# EasyEDA Pro project Cerberus_Sub_Controller_v02.eprj, schematic Cerberus_Sub_Controller_v02, sheets 2 to 3 of 3

## Sheets
2 A2: Page Name: A2
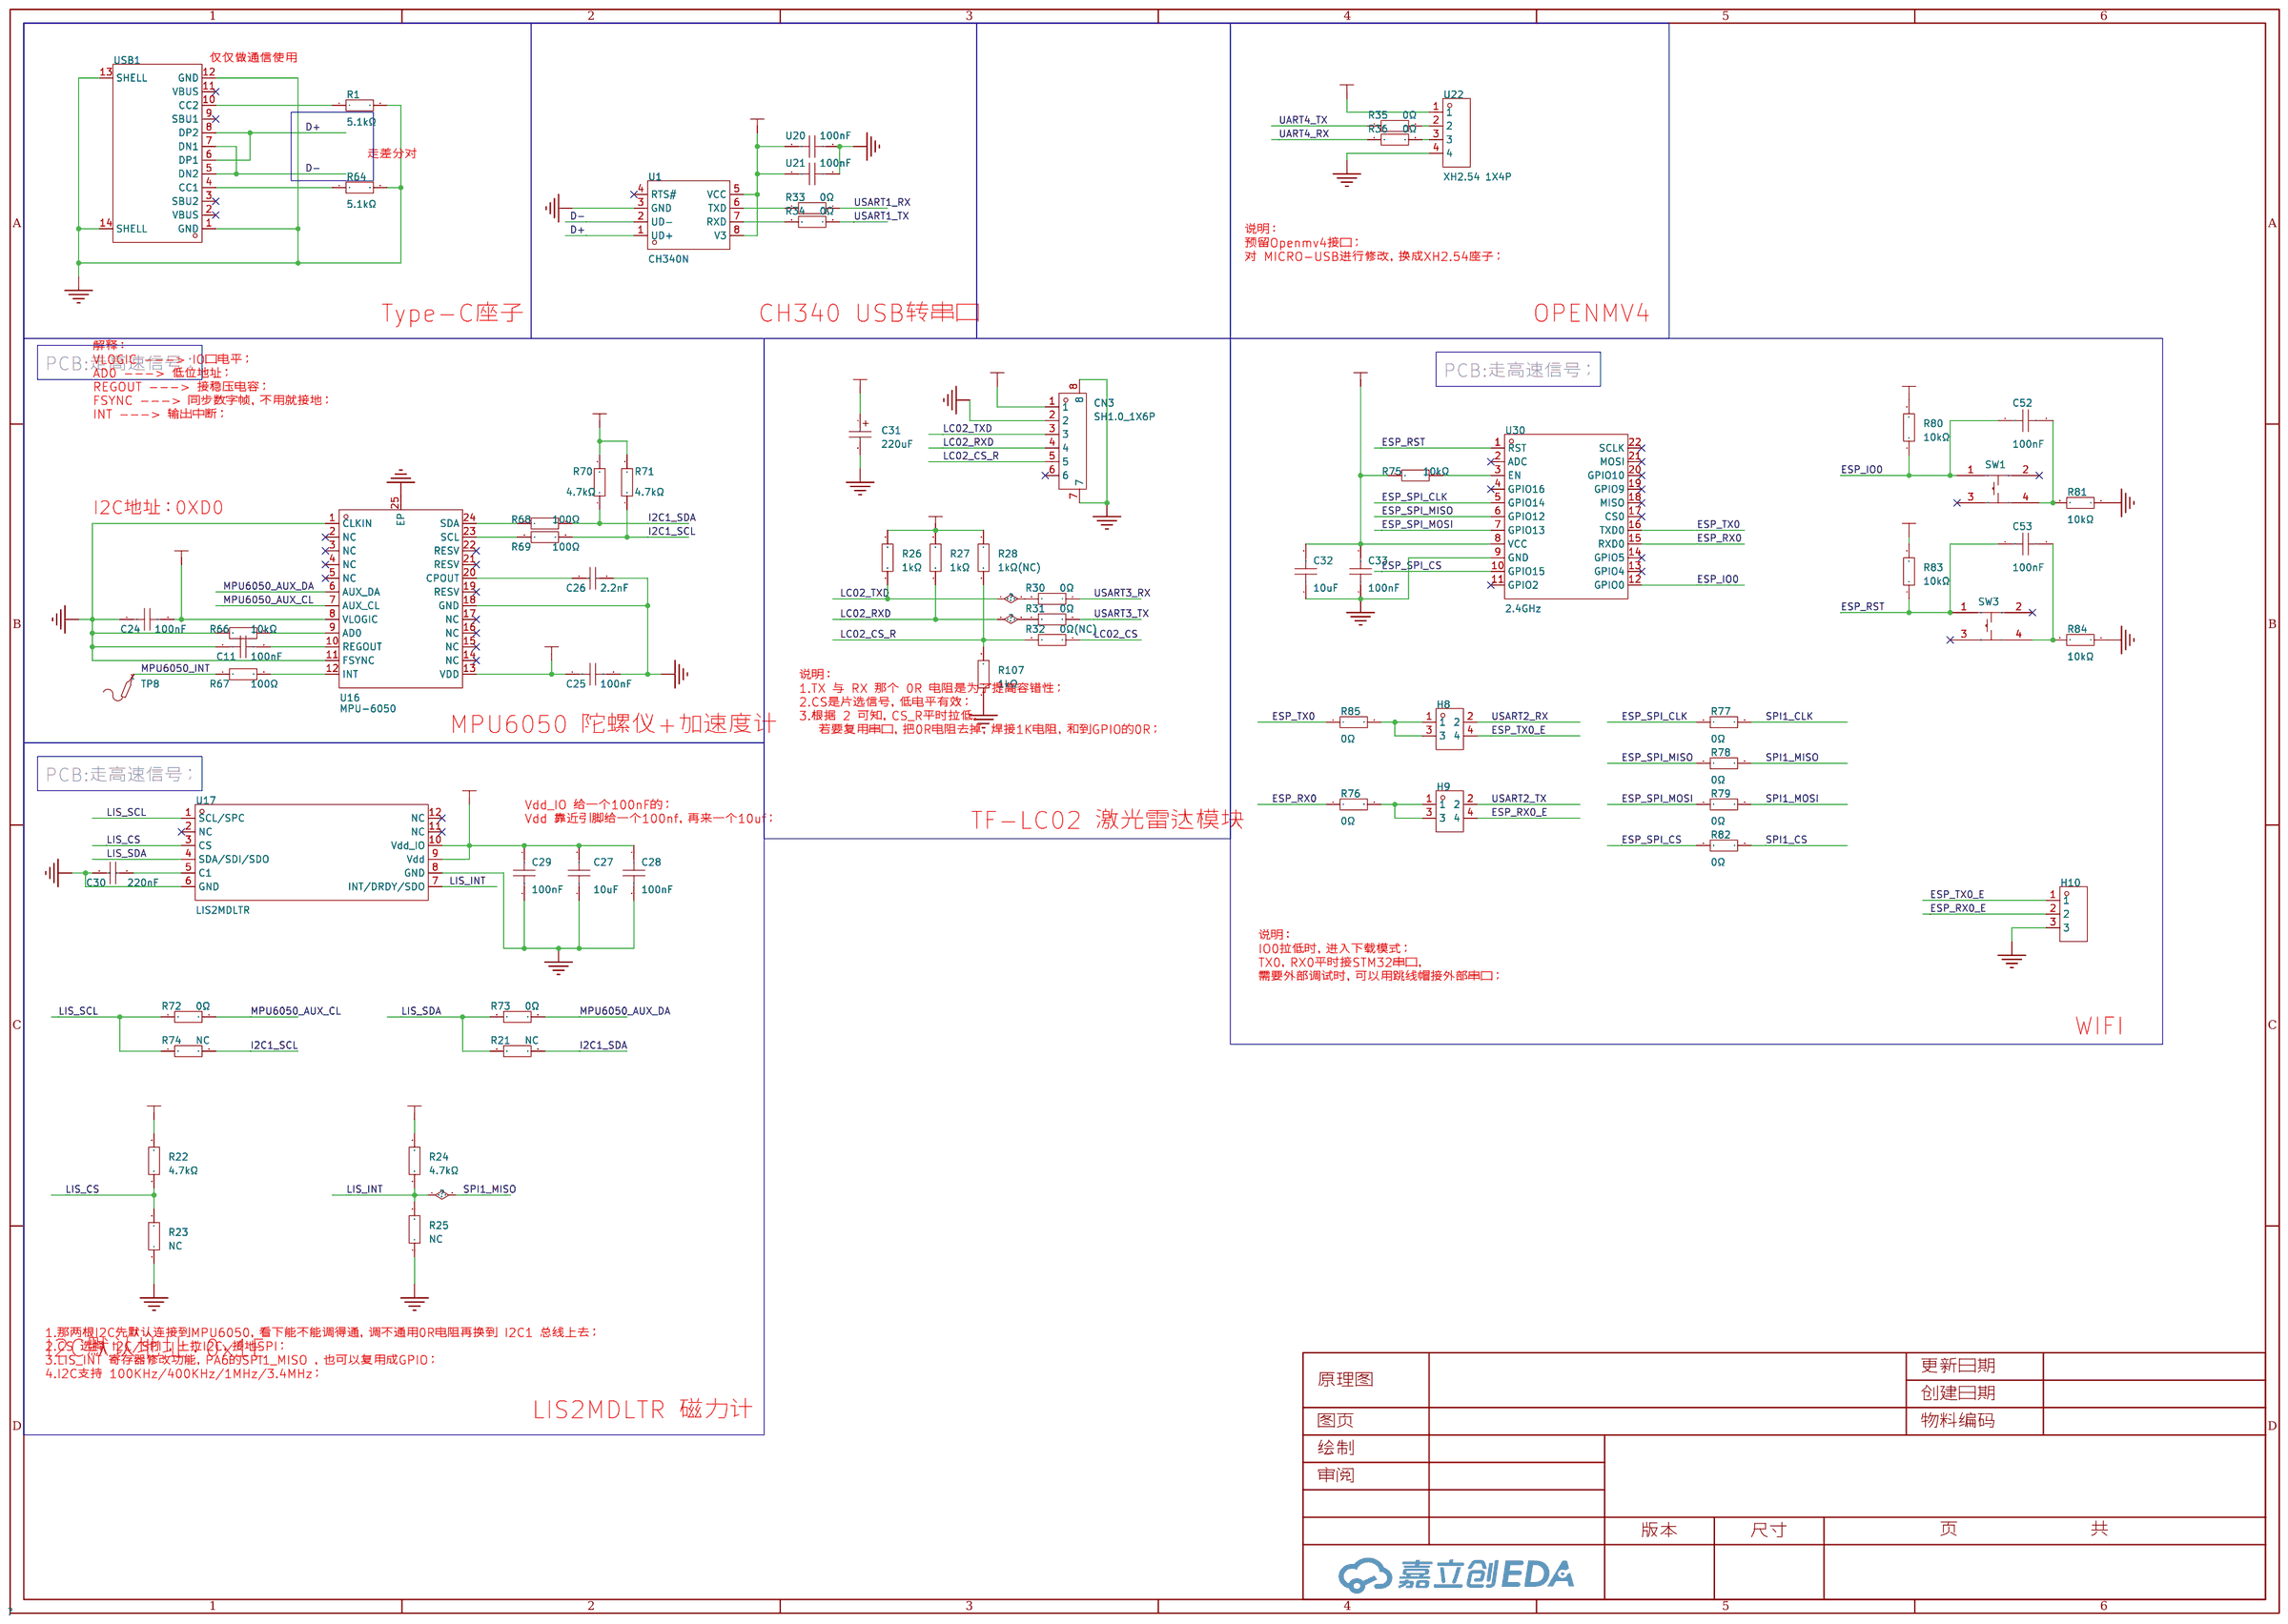
[diagram p1: A2]
3 A3: Page Name: A3
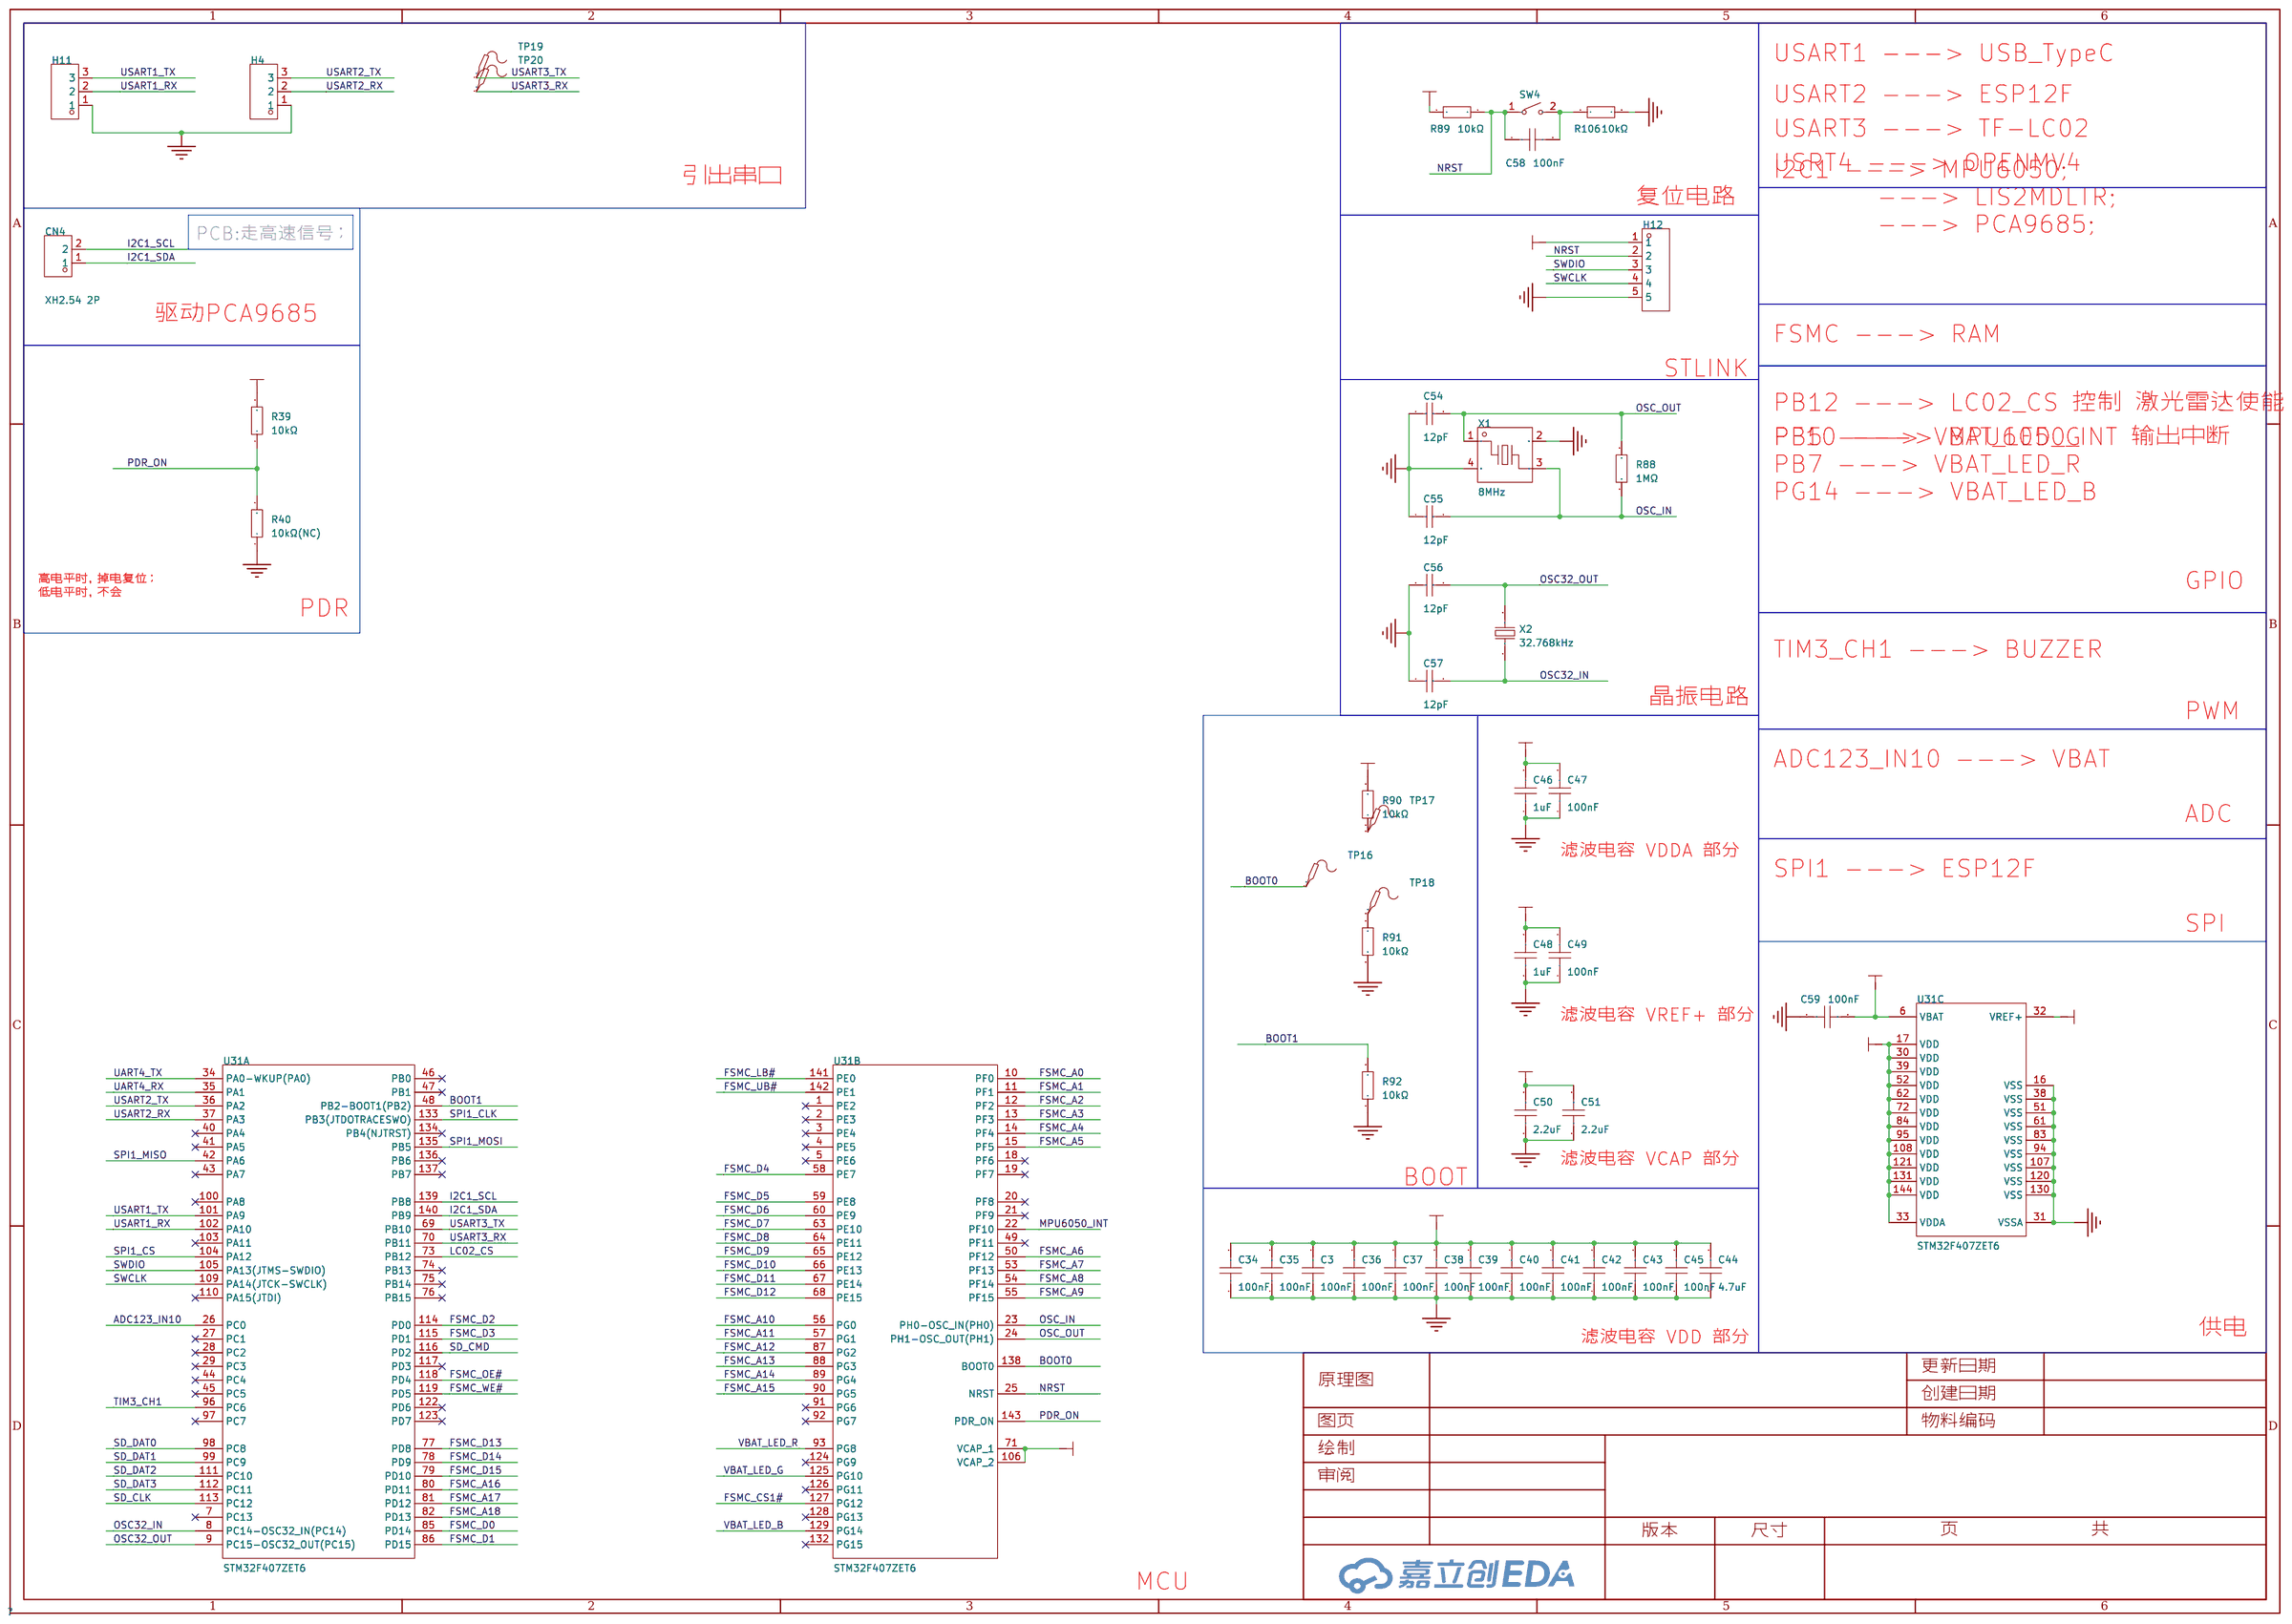
[diagram p2: A3]

## Parts
sheet A2
C11  100nF  [C0402]
C24  100nF  [C0402]
C25  100nF  [C0402]
C26  2.2nF  [C0402]
C27  10uF  [C0402]
C28  100nF  [C0402]
C29  100nF  [C0402]
C30  220nF  [C0402]
C31  220uF  [CAP-SMD_L3.5-W2.8-R-RD]
C32  10uF  [C0603]
C33  100nF  [C0603]
C52  100nF  [C0603]
C53  100nF  [C0603]
CN3  SH1.0_1X6P  [CONN-SMD_6P-P1.00_XUNPU_WAFER-SH1.0-6PWB]
H8  PZ254V-12-4P  [HDR-TH_4P-P2.54-V-M-R2-C2-S2.54]
H9  PZ254V-12-4P  [HDR-TH_4P-P2.54-V-M-R2-C2-S2.54]
H10  PZ254V-11-03P  [HDR-TH_3P-P2.54-V-M]
R1  5.1kΩ  [R0603]
R21  NC  [R0402]
R22  4.7kΩ  [R0402]
R23  NC  [R0402]
R24  4.7kΩ  [R0402]
R25  NC  [R0402]
R26  1kΩ  [R0603]
R27  1kΩ  [R0603]
R28  1kΩ(NC)  [R0603]
R30  0Ω  [R0603]
R31  0Ω  [R0603]
R32  0Ω(NC)  [R0603]
R33  0Ω  [R0603]
R34  0Ω  [R0603]
R35  0Ω  [R0603]
R36  0Ω  [R0603]
R64  5.1kΩ  [R0603]
R66  10kΩ  [R0402]
R67  100Ω  [R0402]
R68  100Ω  [R0402]
R69  100Ω  [R0402]
R70  4.7kΩ  [R0603]
R71  4.7kΩ  [R0603]
R72  0Ω  [R0402]
R73  0Ω  [R0402]
R74  NC  [R0402]
R75  10kΩ  [R0603]
R76  0Ω  [R0603]
R77  0Ω  [R0603]
R78  0Ω  [R0603]
R79  0Ω  [R0603]
R80  10kΩ  [R0603]
R81  10kΩ  [R0603]
R82  0Ω  [R0603]
R83  10kΩ  [R0603]
R84  10kΩ  [R0603]
R85  0Ω  [R0603]
R107  1kΩ  [R0603]
SW1  TS-1009S-04526  [SW-SMD_4P-L4.5-W4.5-P3.00-LS7.0]
SW3  TS-1009S-04526  [SW-SMD_4P-L4.5-W4.5-P3.00-LS7.0]
TP8  -  [Test-Point-0.5mm]
U1  CH340N  [SOP-8_L4.9-W3.9-P1.27-LS6.0-BL]
U16  MPU-6050  [QFN-24_L4.0-W4.0-P0.50-BL-EP2.7]
U17  LIS2MDLTR  [LGA-12_L2.0-W2.0-P0.50-BL]
U20  100nF  [C0603]
U21  100nF  [C0603]
U22  XH2.54 1X4P  [CONN-TH_4P-P2.50_4PIN]
U30  2.4GHz  [WIFIM-SMD_ESP-12F-ESP8266MOD]
USB1  TYPE-C 16PIN 2MD(073)  [USB-C-SMD_TYPE-C-6PIN-2MD-073]
sheet A3
C3  100nF  [C0402]
C34  100nF  [C0402]
C35  100nF  [C0402]
C36  100nF  [C0402]
C37  100nF  [C0402]
C38  100nF  [C0402]
C39  100nF  [C0402]
C40  100nF  [C0402]
C41  100nF  [C0402]
C42  100nF  [C0402]
C43  100nF  [C0402]
C44  4.7uF  [C0402]
C45  100nF  [C0402]
C46  1uF  [C0402]
C47  100nF  [C0402]
C48  1uF  [C0402]
C49  100nF  [C0402]
C50  2.2uF  [C0402]
C51  2.2uF  [C0402]
C54  12pF  [C0402]
C55  12pF  [C0402]
C56  12pF  [C0402]
C57  12pF  [C0402]
C58  100nF  [C0402]
C59  100nF  [C0402]
CN4  XH2.54 2P  [CONN-TH_2P-P2.50_HX25003-2A]
H4  PZ254V-11-03P  [HDR-TH_3P-P2.54-V-M]
H11  PZ254V-11-03P  [HDR-TH_3P-P2.54-V-M]
H12  PZ254V-11-05P  [HDR-TH_5P-P2.54-V-M]
R39  10kΩ  [R0603]
R40  10kΩ(NC)  [R0603]
R88  1MΩ  [R0402]
R89  10kΩ  [R0402]
R90  10kΩ  [R0402]
R91  10kΩ  [R0402]
R92  10kΩ  [R0402]
R106  10kΩ  [R0402]
SW4  TS-1088R-02026  [SW-SMD_L3.9-W3.0-P4.45]
TP16  -  [Test-Point-0.5mm]
TP17  -  [Test-Point-0.5mm]
TP18  -  [Test-Point-0.5mm]
TP19  -  [Test-Point-0.5mm]
TP20  -  [Test-Point-0.5mm]
U31  STM32F407ZET6  [LQFP-144_L20.0-W20.0-P0.50-LS22.0-BL]  (sections 1,2,3)
X1  8MHz  [OSC-SMD_4P-L3.2-W2.5-BL]
X2  32.768kHz  [FC-135R_L3.2-W1.5]

## Library data of the parts
C3 C11 C24 C25 C28 C29 C34-C43 C45 C47 C49 C58 C59 = GRM155R71H104KE14D: 容值:100nF;精度:±10%;额定电压:50V;材质(温度系数):X7R;; LCSC Part Name: 100nF ±10% 50V; Supplier Part: C77020; Manufacturer: muRata(村田); Supplier Footprint: 0402; JLCPCB Part Class: 扩展库; Datasheet: https://atta.szlcsc.com/upload/public/pdf/source/20180326/C77020_39BD49C951FF1AF0DB1F1FAC5AC1E401.pdf; Supplier: LCSC; Tolerance: ±10%; Voltage Rated: 50V; Temperature Coefficient: X7R
C26 = CC0402KRX7R9BB222: 容值:2.2nF;精度:±10%;额定电压:50V;材质(温度系数):X7R;; LCSC Part Name: 2.2nF ±10% 50V; Supplier Part: C106861; Manufacturer: YAGEO(国巨); Supplier Footprint: 0402; JLCPCB Part Class: 扩展库; Datasheet: https://atta.szlcsc.com/upload/public/pdf/source/20170505/1493957848374.pdf; Supplier: LCSC; Tolerance: ±10%; Voltage Rated: 50V; Temperature Coefficient: X7R
C27 = CL05A106MP5NUNC: 容值:10uF;精度:±20%;额定电压:10V;材质(温度系数):X5R;; LCSC Part Name: 10uF ±20% 10V; Supplier Part: C315248; Manufacturer: SAMSUNG(三星); Supplier Footprint: 0402; JLCPCB Part Class: 扩展库; Datasheet: https://atta.szlcsc.com/upload/public/pdf/source/20231220/1EF805BAE1520675928CC4638D279E74.pdf; Supplier: LCSC; Tolerance: ±20%; Voltage Rated: 10V; Temperature Coefficient: X5R
C30 = CL05B224KO5NNNC: 容值:220nF;精度:±10%;额定电压:16V;材质(温度系数):X7R;; LCSC Part Name: 220nF ±10% 16V; Supplier Part: C16772; Manufacturer: SAMSUNG(三星); Supplier Footprint: 0402; JLCPCB Part Class: 基础库; Datasheet: https://atta.szlcsc.com/upload/public/pdf/source/20160218/1457707763339.pdf; Supplier: LCSC; Tolerance: ±10%; Voltage Rated: 16V; Temperature Coefficient: X7R
C31 = CA45-B6R3K227T: 容值:220uF;精度:±10%;额定电压:6.3V;等效串联电阻:1.2Ω@100kHz;; LCSC Part Name: 220uF ±10% 6.3V; Supplier Part: C122649; Manufacturer: 湘怡中元/湘江; Supplier Footprint: CASE-B-3528; JLCPCB Part Class: 扩展库; Datasheet: https://atta.szlcsc.com/upload/public/pdf/source/20191009/C435293_78A410F3D73489DBEAC46056C4262F7A.pdf; Supplier: LCSC; Tolerance: ±10%; Rated Voltage: 6.3V; Equivalent Series Resistance(ESR): 1.2Ω@100kHz; Operating Temperature: -55℃~+125℃
C32 = CL10A106KP8NNNC: 容值:10uF;精度:±10%;额定电压:10V;材质(温度系数):X5R;; LCSC Part Name: 10uF ±10% 10V; Supplier Part: C19702; Manufacturer: SAMSUNG(三星); Supplier Footprint: 0603; JLCPCB Part Class: 基础库; Datasheet: https://atta.szlcsc.com/upload/public/pdf/source/20160218/1457707763339.pdf; Supplier: LCSC; Tolerance: ±10%; Voltage Rated: 10V; Temperature Coefficient: X5R
C33 = CC0603KRX7R9BB104: 容值:100nF;精度:±10%;额定电压:50V;材质(温度系数):X7R;; LCSC Part Name: 100nF ±10% 50V; Supplier Part: C14663; Manufacturer: YAGEO(国巨); Supplier Footprint: 0603; JLCPCB Part Class: 基础库; Datasheet: https://atta.szlcsc.com/upload/public/pdf/source/20180910/C282072_33301C7F631E79921B82A8DAC6BCC5B3.pdf; Supplier: LCSC; Tolerance: ±10%; Voltage Rated: 50V; Temperature Coefficient: X7R
C52 C53 U20 U21 = CGA0603X7R104K500JT: 容值:100nF;精度:±10%;额定电压:50V;材质(温度系数):X7R;; LCSC Part Name: 100nF ±10% 50V; Supplier Part: C6119867; Manufacturer: HRE(芯声); Supplier Footprint: 0603; JLCPCB Part Class: 扩展库; Supplier: LCSC; Tolerance: ±10%; Voltage Rated: 50V; Temperature Coefficient: X7R
CN3 = WAFER-SH1.0-6PWB: 插针结构:1x6P;间距:1mm;安装方式:卧贴;总PIN数:6P;排数:1;每排PIN数:6;额定电流:1A;工作温度范围:-25℃~+85℃;; LCSC Part Name: 1x6P 间距:1mm 卧贴; Supplier Part: C3029345; Manufacturer: XUNPU(讯普); Supplier Footprint: SMD,P=1mm,卧贴; JLCPCB Part Class: 扩展库; Datasheet: https://atta.szlcsc.com/upload/public/pdf/source/20220527/1879B8210BD3B2006BCEAC1A40D397B6.pdf; Supplier: LCSC; Pins Structure: 1x6P; Pitch: 1mm; Mounting Style: 卧贴; Number of Pins: 6P; Number of Rows: 1; Number of PINs Per Row: 6; Current Rating (Max): 1A; Operating Temperature Range: -25℃~+85℃
H8 H9 = PZ254V-12-4P: 插针结构:2x2P;间距:2.54mm;行距:2.54mm;圆针/方针:方针;安装类型:直插;排数:双排;总PIN位数:4P;额定电流:-;额定电压:-;配合针长度:6mm;塑高:2.5mm;端接针长度:3mm;触头材质:黄铜;触头镀层:-;工作温度范围:-40℃~+105℃;颜色:黑色;; LCSC Part Name: 间距:2.54mm 2x2P 直插 方针; Supplier Part: C492419; Manufacturer: XFCN(兴飞); Supplier Footprint: 插件,P=2.54mm; JLCPCB Part Class: 扩展库; Datasheet: https://atta.szlcsc.com/upload/public/pdf/source/20200309/C492419_0001C06E73AFF21BD0ED3D7CEEF46D29.pdf; Supplier: LCSC; Pin Structure: 2x2P; Pitch: 2.54mm; Row Spacing: 2.54mm; Circluar Pins/Square Pins: 方针; Mounting Type: 直插; Number of Rows: 双排; Number of Pins: 4P; Length of Mating Pin: 6mm; Insulation Height: 2.5mm; Length of End Connection Pin: 3mm; Contact Material: 黄铜; Operating Temperature Range: -40℃~+105℃; Color: 黑色
H4 H10 H11 = PZ254V-11-03P: 插针结构:1x3P;间距:2.54mm;行距:-;圆针/方针:方针;安装类型:直插;排数:单排;总PIN位数:3P;额定电流:3A;额定电压:250V;配合针长度:6mm;塑高:2.5mm;端接针长度:3mm;工作温度范围:-40℃~+105℃;颜色:黑色;; LCSC Part Name: 间距:2.54mm 1x3P 直插 方针; Supplier Part: C2937625; Manufacturer: XFCN(兴飞); Supplier Footprint: 插件,P=2.54mm; JLCPCB Part Class: 扩展库; Datasheet: https://atta.szlcsc.com/upload/public/pdf/source/20200309/C492402_8335C3D49C4E4C618838D59BB1D024C1.pdf; Supplier: LCSC; Pin Structure: 1x3P; Pitch: 2.54mm; Circluar Pins/Square Pins: 方针; Mounting Type: 直插; Number of Rows: 单排; Number of Pins: 3P; Current Rating (Max): 3A; Voltage Rating (Max): 250V; Length of Mating Pin: 6mm; Insulation Height: 2.5mm; Length of End Connection Pin: 3mm; Operating Temperature Range: -40℃~+105℃; Color: 黑色
R1 R64 = 0603WAF5101T5E: 电阻类型:厚膜电阻;阻值:5.1kΩ;精度:±1%;功率:100mW;最大工作电压:75V;温度系数:±100ppm/℃;; LCSC Part Name: 5.1kΩ ±1% 100mW 厚膜电阻; Supplier Part: C23186; Manufacturer: UNI-ROYAL(厚声); Supplier Footprint: 0603; JLCPCB Part Class: 基础库; Datasheet: https://atta.szlcsc.com/upload/public/pdf/source/20200306/C422600_1E6D84923E4A46A82E41ADD87F860B5C.pdf; Supplier: LCSC; Type: 厚膜电阻; Tolerance: ±1%; Power(Watts): 100mW; Overload Voltage (Max): 75V; Temperature Coefficient: ±100ppm/℃; Operating Temperature Range: -55℃~+155℃
R21 R72-R74 = 0402WGF0000TCE: 电阻类型:厚膜电阻;阻值:0Ω;精度:±1%;功率:62.5mW;最大工作电压:50V;温度系数:±800ppm/℃;; LCSC Part Name: 0Ω ±1% 62.5mW 厚膜电阻; Supplier Part: C17168; Manufacturer: UNI-ROYAL(厚声); Supplier Footprint: 0402; JLCPCB Part Class: 基础库; Datasheet: https://atta.szlcsc.com/upload/public/pdf/source/20200306/C422600_1E6D84923E4A46A82E41ADD87F860B5C.pdf; Supplier: LCSC; Type: 厚膜电阻; Tolerance: ±1%; Power(Watts): 62.5mW; Overload Voltage (Max): 50V; Temperature Coefficient: ±800ppm/℃; Operating Temperature Range: -55℃~+155℃
R22-R25 = 0402WGJ0472TCE: 电阻类型:厚膜电阻;阻值:4.7kΩ;精度:±5%;功率:62.5mW;最大工作电压:50V;温度系数:±100ppm/℃;; LCSC Part Name: 4.7kΩ ±5% 62.5mW 厚膜电阻; Supplier Part: C25940; Manufacturer: UNI-ROYAL(厚声); Supplier Footprint: 0402; JLCPCB Part Class: 扩展库; Datasheet: https://atta.szlcsc.com/upload/public/pdf/source/20200306/C422600_1E6D84923E4A46A82E41ADD87F860B5C.pdf; Supplier: LCSC; Type: 厚膜电阻; Tolerance: ±5%; Power(Watts): 62.5mW; Overload Voltage (Max): 50V; Temperature Coefficient: ±100ppm/℃; Operating Temperature Range: -55℃~+155℃
R26-R28 R107 = RC0603FR-071KL: 电阻类型:厚膜电阻;阻值:1kΩ;精度:±1%;功率:100mW;最大工作电压:75V;温度系数:±100ppm/℃;; LCSC Part Name: 厚膜电阻 1kΩ ±1% 100mW; Supplier Part: C22548; Manufacturer: YAGEO(国巨); Supplier Footprint: 0603; JLCPCB Part Class: 扩展库; Datasheet: https://atta.szlcsc.com/upload/public/pdf/source/20180316/70C0E2BDAE7FCC62C531A5A58D202EE1.pdf; Supplier: LCSC; Type: 厚膜电阻; Tolerance: ±1%; Power(Watts): 100mW; Overload Voltage (Max): 75V; Temperature Coefficient: ±100ppm/℃; Operating Temperature Range: -55℃~+155℃
R30-R36 R76-R79 R82 R85 = 0603WAF0000T5E: 电阻类型:厚膜电阻;阻值:0Ω;精度:±1%;功率:100mW;最大工作电压:75V;; LCSC Part Name: 0Ω ±1% 100mW 厚膜电阻; Supplier Part: C21189; Manufacturer: UNI-ROYAL(厚声); Supplier Footprint: 0603; JLCPCB Part Class: 基础库; Datasheet: https://atta.szlcsc.com/upload/public/pdf/source/20200306/C422600_1E6D84923E4A46A82E41ADD87F860B5C.pdf; Supplier: LCSC; Type: 厚膜电阻; Tolerance: ±1%; Power(Watts): 100mW; Overload Voltage (Max): 75V; Operating Temperature Range: -55℃~+155℃
R66 R89-R92 R106 = RC0402FR-0710KL: 电阻类型:厚膜电阻;阻值:10kΩ;精度:±1%;功率:62.5mW;最大工作电压:50V;温度系数:±100ppm/℃;; LCSC Part Name: 厚膜电阻 10kΩ ±1% 62.5mW; Supplier Part: C60490; Manufacturer: YAGEO(国巨); Supplier Footprint: 0402; JLCPCB Part Class: 扩展库; Datasheet: https://atta.szlcsc.com/upload/public/pdf/source/20170925/C131467_1506321478108990263.pdf; Supplier: LCSC; Type: 厚膜电阻; Tolerance: ±1%; Power(Watts): 62.5mW; Overload Voltage (Max): 50V; Temperature Coefficient: ±100ppm/℃; Operating Temperature Range: -55℃~+155℃
R67-R69 = 0402WGF1000TCE: 电阻类型:厚膜电阻;阻值:100Ω;精度:±1%;功率:62.5mW;最大工作电压:50V;温度系数:±200ppm/℃;; LCSC Part Name: 100Ω ±1% 62.5mW 厚膜电阻; Supplier Part: C25076; Manufacturer: UNI-ROYAL(厚声); Supplier Footprint: 0402; JLCPCB Part Class: 基础库; Datasheet: https://atta.szlcsc.com/upload/public/pdf/source/20200306/C422600_1E6D84923E4A46A82E41ADD87F860B5C.pdf; Supplier: LCSC; Type: 厚膜电阻; Tolerance: ±1%; Power(Watts): 62.5mW; Overload Voltage (Max): 50V; Temperature Coefficient: ±200ppm/℃; Operating Temperature Range: -55℃~+155℃
R70 R71 = 0603WAF4701T5E: 电阻类型:厚膜电阻;阻值:4.7kΩ;精度:±1%;功率:100mW;最大工作电压:75V;温度系数:±100ppm/℃;; LCSC Part Name: 4.7kΩ ±1% 100mW 厚膜电阻; Supplier Part: C23162; Manufacturer: UNI-ROYAL(厚声); Supplier Footprint: 0603; JLCPCB Part Class: 基础库; Datasheet: https://atta.szlcsc.com/upload/public/pdf/source/20200306/C422600_1E6D84923E4A46A82E41ADD87F860B5C.pdf; Supplier: LCSC; Type: 厚膜电阻; Tolerance: ±1%; Power(Watts): 100mW; Overload Voltage (Max): 75V; Temperature Coefficient: ±100ppm/℃; Operating Temperature Range: -55℃~+155℃
R39 R40 R75 R80 R81 R83 R84 = 0603WAF1002T5E: 电阻类型:厚膜电阻;阻值:10kΩ;精度:±1%;功率:100mW;最大工作电压:75V;温度系数:±100ppm/℃;; LCSC Part Name: 厚膜电阻 10kΩ ±1% 100mW; Supplier Part: C25804; Manufacturer: UNI-ROYAL(厚声); Supplier Footprint: 0603; JLCPCB Part Class: 基础库; Datasheet: https://atta.szlcsc.com/upload/public/pdf/source/20200306/C422600_1E6D84923E4A46A82E41ADD87F860B5C.pdf; Supplier: LCSC; Type: 厚膜电阻; Tolerance: ±1%; Power(Watts): 100mW; Overload Voltage (Max): 75V; Temperature Coefficient: ±100ppm/℃; Operating Temperature Range: -55℃~+155℃
SW1 SW3 = TS-1009S-04526: 电路结构:单刀单掷;按钮形状:圆形按钮;安装方式:立贴;开关长度:4.5mm;开关宽度:4.5mm;开关高度:4.5mm;触点电流:50mA;额定电压(DC):12V;带灯:-;机械寿命:-;; LCSC Part Name: 4.5*4.5*4.5mm 立贴 轻触开关; Supplier Part: C455245; Manufacturer: XUNPU(讯普); Supplier Footprint: SMD,4.5x4.5mm; JLCPCB Part Class: 扩展库; Datasheet: https://atta.szlcsc.com/upload/public/pdf/source/20191118/C455248_D35D7E271EC7BD44939E7F982BCB1632.pdf; Supplier: LCSC; Circuit: 单刀单掷; Actuator Style: 圆形按钮; Mounting Style: 立贴; Switch Length: 4.5mm; Switch Width: 4.5mm; Switch Height: 4.5mm; Contact Current: 50mA; Voltage Rating (DC): 12V
TP8 TP16-TP20 = Test-Point: Test Point 测试点
U1 = CH340N: LCSC Part Name: USB转串口芯片 CH340; Supplier Part: C2977777; Manufacturer: WCH(南京沁恒); Supplier Footprint: SOP-8; JLCPCB Part Class: 扩展库; Datasheet: https://atta.szlcsc.com/upload/public/pdf/source/20230530/6E401E9554E9F5311886CC8B3F89B62E.pdf; Supplier: LCSC
U16 = MPU-6050: 传感器类型:加速度计陀螺仪;; Supplier Part: C24112; Manufacturer: TDK InvenSense(应美盛); Supplier Footprint: QFN-24-EP(4x4); JLCPCB Part Class: 扩展库; Datasheet: https://atta.szlcsc.com/upload/public/pdf/source/20140425/1457707046159.pdf; Supplier: LCSC; Sensor Type: 加速度计陀螺仪; Operating Temperature: -40℃~+85℃
U17 = LIS2MDLTR: 磁传感器、数字输出、50高斯磁场动态范围、超低功耗、高性能、3轴磁力计; LCSC Part Name: 霍尔效应开关; Supplier Part: C919695; Manufacturer: ST(意法半导体); Supplier Footprint: LGA-12(2x2); JLCPCB Part Class: 扩展库; Datasheet: https://atta.szlcsc.com/upload/public/pdf/source/20211119/145E3A73C2A09E2C981D93C27CF540FA.pdf; Supplier: LCSC
U22 = ZX-XH2.54-4PZZ: 插针结构:1x4P;间距:2.54mm;安装方式:直插;参考系列:XH;总PIN数:4P;排数:1;每排PIN数:4;行距:-;额定电流:3A;触头材质:黄铜;触头镀层:锡;工作温度范围:-25℃~+85℃;; Supplier Part: C7429634; Manufacturer: Megastar(兆星); Supplier Footprint: 插件,P=2.54mm; JLCPCB Part Class: 扩展库; Datasheet: https://atta.szlcsc.com/upload/public/pdf/source/20230619/B529A2163E0159A644AB3383D208FB03.pdf; Supplier: LCSC; Pins Structure: 1x4P; Pitch: 2.54mm; Mounting Style: 直插; Reference Series: XH; Number of Pins: 4P; Number of Rows: 1; Number of PINs Per Row: 4; Current Rating (Max): 3A; Contact Material: 黄铜; Contact Plating: 锡; Operating Temperature Range: -25℃~+85℃
U30 = ESP-12F(ESP8266MOD): 核心处理器:ESP8266芯片;频率:2.4GHz;天线形式:板载PCB天线;发射功率:16dBm;接收灵敏度:-90dBm;; LCSC Part Name: 完整的802.11b/g/nWi-FiSoC模块; Supplier Part: C82891; Manufacturer: Ai-Thinker(安信可); Supplier Footprint: SMD,16x24mm; JLCPCB Part Class: 扩展库; Datasheet: https://atta.szlcsc.com/upload/public/pdf/source/20210219/C82891_ABD84A460F4F056A2757267CCCA4B508.pdf; Supplier: LCSC; Core Processor: ESP8266芯片; Support Interface: GPIO；UART；I2C；PWM；SPI；ADC; Antenna Type: 板载PCB天线; Output Power: 16dBm; Operating Voltage: 3.3V; Receive  Current: 120mA; Send  Current: 170mA; Sensitivity: -90dBm; Operating Temperature: -40℃~+85℃
USB1 = TYPE-C 16PIN 2MD(073): 连接器类型:Type-C;标准:-;公母:母;端口数量:1;触点数量:16P;安装方式:卧贴;额定电流 - 电源:5A;工作温度范围:-25℃~+85℃;; LCSC Part Name: Type-C 母 卧贴; Supplier Part: C2765186; Manufacturer: SHOU HAN(首韩); Supplier Footprint: SMD; JLCPCB Part Class: 扩展库; Datasheet: https://atta.szlcsc.com/upload/public/pdf/source/20211123/39B17C16241EAC15C5E277BDA434118E.pdf; Supplier: LCSC; Connector Type: Type-C; Gender: 母; Number of Ports: 1; Number of Contacts: 16P; Mounting Style: 卧贴; Current Rating - Power (Max): 5A; Operating Temperature Range: -25℃~+85℃
C44 = CL05A475KP5NRNC: 容值:4.7uF;精度:±10%;额定电压:10V;材质(温度系数):X5R;; LCSC Part Name: 4.7uF ±10% 10V; Supplier Part: C368809; Manufacturer: SAMSUNG(三星); Supplier Footprint: 0402; JLCPCB Part Class: 扩展库; Datasheet: https://atta.szlcsc.com/upload/public/pdf/source/20160218/1457707763339.pdf; Supplier: LCSC; Tolerance: ±10%; Voltage Rated: 10V; Temperature Coefficient: X5R
C46 C48 = CL05A105KA5NQNC: 容值:1uF;精度:±10%;额定电压:25V;材质(温度系数):X5R;; LCSC Part Name: 1uF ±10% 25V; Supplier Part: C52923; Manufacturer: SAMSUNG(三星); Supplier Footprint: 0402; JLCPCB Part Class: 基础库; Datasheet: https://atta.szlcsc.com/upload/public/pdf/source/20160218/1457707763339.pdf; Supplier: LCSC; Tolerance: ±10%; Voltage Rated: 25V; Temperature Coefficient: X5R
C50 C51 = GRM155R61E225KE11D: 容值:2.2uF;精度:±10%;额定电压:25V;材质(温度系数):X5R;; LCSC Part Name: 2.2uF ±10% 25V; Supplier Part: C385032; Manufacturer: muRata(村田); Supplier Footprint: 0402; JLCPCB Part Class: 扩展库; Datasheet: https://atta.szlcsc.com/upload/public/pdf/source/20190531/C385032_AE390FF415271BC6A7223A7F56F516ED.pdf; Supplier: LCSC; Tolerance: ±10%; Voltage Rated: 25V; Temperature Coefficient: X5R
C54-C57 = 0402CG120J500NT: 容值:12pF;精度:±5%;额定电压:50V;材质(温度系数):C0G;; LCSC Part Name: 12pF ±5% 50V; Supplier Part: C1547; Manufacturer: FH(风华); Supplier Footprint: 0402; JLCPCB Part Class: 基础库; Datasheet: https://atta.szlcsc.com/upload/public/pdf/source/20200305/C486355_26A10D38EF8C2A5C37091D0039909270.pdf; Supplier: LCSC; Tolerance: ±5%; Voltage Rated: 50V; Temperature Coefficient: C0G
CN4 = ZX-XH2.54-2PZZ: 插针结构:1x2P;间距:2.54mm;安装方式:直插;参考系列:XH;总PIN数:2P;排数:1;每排PIN数:2;行距:-;额定电流:3A;触头材质:黄铜;触头镀层:锡;工作温度范围:-25℃~+85℃;; Supplier Part: C7429632; Manufacturer: Megastar(兆星); Supplier Footprint: 插件,P=2.54mm; JLCPCB Part Class: 扩展库; Datasheet: https://atta.szlcsc.com/upload/public/pdf/source/20230619/19BA6947230AA44A04D3EDD65E618FD0.pdf; Supplier: LCSC; Pins Structure: 1x2P; Pitch: 2.54mm; Mounting Style: 直插; Reference Series: XH; Number of Pins: 2P; Number of Rows: 1; Number of PINs Per Row: 2; Current Rating (Max): 3A; Contact Material: 黄铜; Contact Plating: 锡; Operating Temperature Range: -25℃~+85℃
H12 = PZ254V-11-05P: 插针结构:1x5P;间距:2.54mm;行距:-;圆针/方针:方针;安装类型:直插;排数:单排;总PIN位数:5P;额定电流:-;额定电压:-;配合针长度:6mm;塑高:2.5mm;端接针长度:3mm;触头材质:黄铜;触头镀层:-;工作温度范围:-40℃~+105℃;颜色:黑色;; LCSC Part Name: 间距:2.54mm 1x5P 直插 方针; Supplier Part: C492404; Manufacturer: XFCN(兴飞); Supplier Footprint: 插件,P=2.54mm; JLCPCB Part Class: 扩展库; Datasheet: https://atta.szlcsc.com/upload/public/pdf/source/20200309/C492404_E51533260F8710EFF5D4617281164C1D.pdf; Supplier: LCSC; Pin Structure: 1x5P; Pitch: 2.54mm; Circluar Pins/Square Pins: 方针; Mounting Type: 直插; Number of Rows: 单排; Number of Pins: 5P; Length of Mating Pin: 6mm; Insulation Height: 2.5mm; Length of End Connection Pin: 3mm; Contact Material: 黄铜; Operating Temperature Range: -40℃~+105℃; Color: 黑色
R88 = 0402WGF1004TCE: 电阻类型:厚膜电阻;阻值:1MΩ;精度:±1%;功率:62.5mW;最大工作电压:50V;温度系数:±100ppm/℃;; LCSC Part Name: 1MΩ ±1% 62.5mW 厚膜电阻; Supplier Part: C26083; Manufacturer: UNI-ROYAL(厚声); Supplier Footprint: 0402; JLCPCB Part Class: 基础库; Datasheet: https://atta.szlcsc.com/upload/public/pdf/source/20200306/C422600_1E6D84923E4A46A82E41ADD87F860B5C.pdf; Supplier: LCSC; Type: 厚膜电阻; Tolerance: ±1%; Power(Watts): 62.5mW; Overload Voltage (Max): 50V; Temperature Coefficient: ±100ppm/℃; Operating Temperature Range: -55℃~+155℃
SW4 = TS-1088R-02026: 电路结构:单刀单掷;按钮形状:圆形按钮;安装方式:立贴;开关长度:3.9mm;开关宽度:2.93mm;开关高度:2mm;触点电流:50mA;额定电压(DC):12V;带灯:-;机械寿命:-;; LCSC Part Name: 3.9*2.93*2mm 立贴 轻触开关; Supplier Part: C455280; Manufacturer: XUNPU(讯普); Supplier Footprint: SMD,3x4mm; JLCPCB Part Class: 扩展库; Datasheet: https://atta.szlcsc.com/upload/public/pdf/source/20191118/C455281_EC5379764BC1462550DF64BBBFEA9579.pdf; Supplier: LCSC; Circuit: 单刀单掷; Actuator Style: 圆形按钮; Mounting Style: 立贴; Switch Length: 3.9mm; Switch Width: 2.93mm; Switch Height: 2mm; Contact Current: 50mA; Voltage Rating (DC): 12V
U31 = STM32F407ZET6: CPU内核:ARM-M4;程序存储容量:512KB;RAM总容量:192KB;GPIO端口数量:114;工作电压范围:1.8V~3.6V;CPU最大主频:168MHz;程序存储器类型:FLASH;; LCSC Part Name: 带DSP和FPU的高性能基础系列ARM Cortex-M4 MCU，具有512 KB Flash、168 MHz CPU、ART加速器、以太网和FSMC; Supplier Part: C36869; Manufacturer: ST(意法半导体); Supplier Footprint: LQFP-144(20x20); JLCPCB Part Class: 扩展库; Datasheet: https://atta.szlcsc.com/upload/public/pdf/source/20160816/1471342957598.pdf; Supplier: LCSC; CPU Core: ARM-M4; Program Storage Size: 512KB; RAM Size: 192KB; GPIO Ports Number: 114; Operating Voltage Range: 1.8V~3.6V; CPU Maximum Speed: 168MHz; Program Memory Type: FLASH; Operating Temperature Range: -40℃~+85℃; ADC (Bit): 12bit; DAC (Bit): 12bit; Universal Serial Bus: 有; Watchdog: 有; Infrared Data Association: 有; Low-Voltage Detect: 有; LCD Module: 有; Direct Memory Access: 有; Internal Oscillator: 有
X1 = X32258MOB4SI: 晶振类型:贴片晶振;频率:8MHz;常温频差:±10ppm;外接负载电容:12pF;频率稳定度(全温):±20ppm;; LCSC Part Name: 8MHz ±10ppm 12pF; Supplier Part: C2682775; Manufacturer: YXC(扬兴晶振); Supplier Footprint: SMD3225-4P; JLCPCB Part Class: 扩展库; Datasheet: https://atta.szlcsc.com/upload/public/pdf/source/20240329/19D5F850207469550BEB00D7DFEDBC7A.pdf; Supplier: LCSC; Crystal Type: 贴片晶振; Normal temperature Frequency Tolerance: ±10ppm; External load capacitor: 12pF; Frequency Stability(Full temperature range): ±20ppm; Equivalent Series Resistance (ESR): 150Ω; Operating Temperature: -40℃~+85℃
X2 = Q13FC13500004_C32346: 晶振类型:贴片晶振;频率:32.768kHz;常温频差:±20ppm;外接负载电容:12.5pF;; LCSC Part Name: 32.768kHz ±20ppm 12.5pF; Supplier Part: C32346; Manufacturer: EPSON(爱普生); Manufacturer Part: Q13FC13500004; Supplier Footprint: SMD3215-2P; JLCPCB Part Class: 基础库; Datasheet: https://atta.szlcsc.com/upload/public/pdf/source/20240418/0E0FF5F0356BA3753F616001439D1416.pdf; Supplier: LCSC; Crystal Type: 贴片晶振; Normal temperature Frequency Tolerance: ±20ppm; External load capacitor: 12.5pF; Equivalent Series Resistance (ESR): 70kΩ; Operating Temperature: -40℃~+85℃

## Nets
GND: C3.1 C11.1 C24.1 C25.2 C26.2 C27.1 C28.2 C29.2 C30.1 C31.2 C32.1 C33.1 C34.1 C35.1 C36.1 C37.1 C38.1 C39.1 C40.1 C41.1 C42.1 C43.1 C44.1 C45.1 C46.1 C47.1 C48.1 C49.1 C50.1 C51.1 C54.1 C55.1 C56.1 C57.1 C59.2 CN3.2 CN3.7 CN3.8 H4.1 H10.3 H11.1 H12.5 R1.2 R23.1 R25.1 R40.1 R64.2 R66.1 R81.1 R84.1 R91.1 R92.1 R106.2 R107.1 U1.3(GND) U16.1(CLKIN) U16.11(FSYNC) U16.18(GND) U16.25(EP) U17.6(GND) U17.8(GND) U20.1 U21.1 U22.4 U30.9(GND) U31.16(VSS) U31.31(VSSA) U31.38(VSS) U31.51(VSS) U31.61(VSS) U31.83(VSS) U31.94(VSS) U31.107(VSS) U31.120(VSS) U31.130(VSS) USB1.1(GND) USB1.12(GND) USB1.13(SHELL) USB1.14(SHELL) X1.2(GND) X1.4(GND) ; also on sheet 1
VBAT_LED_B: U31.129(PG14) ; also on sheet 1
VBAT_LED_G: U31.125(PG10) ; also on sheet 1
VBAT_LED_R: U31.93(PG8) ; also on sheet 1
VCC_5V: U22.1 ; also on sheet 1
VCC_ESP_3V3: C32.2 C33.2 R75.1 R80.2 R83.2 U30.8(VCC) ; also on sheet 1
VCC_MCU_3V3: C3.2 C34.2 C35.2 C36.2 C37.2 C38.2 C39.2 C40.2 C41.2 C42.2 C43.2 C44.2 C45.2 C46.2 C47.2 C48.2 C49.2 C50.2 C51.2 C59.1 H12.1 R39.2 R90.2 U31.6(VBAT) U31.17(VDD) U31.30(VDD) U31.32(VREF+) U31.33(VDDA) U31.39(VDD) U31.52(VDD) U31.62(VDD) U31.71(VCAP_1) U31.72(VDD) U31.84(VDD) U31.95(VDD) U31.106(VCAP_2) U31.108(VDD) U31.121(VDD) U31.131(VDD) U31.144(VDD) ; also on sheet 1
VCC_PER_3V3: C24.2 C25.1 C27.2 C28.1 C29.1 C31.1 CN3.1 R22.2 R24.2 R26.2 R27.2 R28.2 R70.2 R71.2 R89.1 U1.5(VCC) U1.8(V3) U16.8(VLOGIC) U16.13(VDD) U17.9(Vdd) U17.10(Vdd_IO) U20.2 U21.2 ; also on sheet 1
ADC123_IN10: U31.26(PC0) ; also on sheet 1
BOOT0: TP16.1 U31.138(BOOT0)
BOOT1: R92.2 U31.48(PB2-BOOT1(PB2))
D+: U1.1(UD+) USB1.6(DP1) USB1.8(DP2)
D-: U1.2(UD-) USB1.5(DN2) USB1.7(DN1)
ESP_IO0: C52.1 R80.1 SW1.1 U30.12(GPIO0)
ESP_RST: C53.1 R83.1 SW3.1 U30.1(RST)
ESP_RX0: R76.1 U30.15(RXD0)
ESP_RX0_E: H9.4 H10.2
ESP_SPI_CLK: R77.1 U30.5(GPIO14)
ESP_SPI_CS: R82.1 U30.10(GPIO15)
ESP_SPI_MISO: R78.1 U30.6(GPIO12)
ESP_SPI_MOSI: R79.1 U30.7(GPIO13)
ESP_TX0: R85.1 U30.16(TXD0)
ESP_TX0_E: H8.4 H10.1
FSMC_A0: U31.10(PF0) ; also on sheet 1
FSMC_A1: U31.11(PF1) ; also on sheet 1
FSMC_A2: U31.12(PF2) ; also on sheet 1
FSMC_A3: U31.13(PF3) ; also on sheet 1
FSMC_A4: U31.14(PF4) ; also on sheet 1
FSMC_A5: U31.15(PF5) ; also on sheet 1
FSMC_A6: U31.50(PF12) ; also on sheet 1
FSMC_A7: U31.53(PF13) ; also on sheet 1
FSMC_A8: U31.54(PF14) ; also on sheet 1
FSMC_A9: U31.55(PF15) ; also on sheet 1
FSMC_A10: U31.56(PG0) ; also on sheet 1
FSMC_A11: U31.57(PG1) ; also on sheet 1
FSMC_A12: U31.87(PG2) ; also on sheet 1
FSMC_A13: U31.88(PG3) ; also on sheet 1
FSMC_A14: U31.89(PG4) ; also on sheet 1
FSMC_A15: U31.90(PG5) ; also on sheet 1
FSMC_A16: U31.80(PD11) ; also on sheet 1
FSMC_A17: U31.81(PD12) ; also on sheet 1
FSMC_A18: U31.82(PD13) ; also on sheet 1
FSMC_CS1#: U31.127(PG12) ; also on sheet 1
FSMC_D0: U31.85(PD14) ; also on sheet 1
FSMC_D1: U31.86(PD15) ; also on sheet 1
FSMC_D2: U31.114(PD0) ; also on sheet 1
FSMC_D3: U31.115(PD1) ; also on sheet 1
FSMC_D4: U31.58(PE7) ; also on sheet 1
FSMC_D5: U31.59(PE8) ; also on sheet 1
FSMC_D6: U31.60(PE9) ; also on sheet 1
FSMC_D7: U31.63(PE10) ; also on sheet 1
FSMC_D8: U31.64(PE11) ; also on sheet 1
FSMC_D9: U31.65(PE12) ; also on sheet 1
FSMC_D10: U31.66(PE13) ; also on sheet 1
FSMC_D11: U31.67(PE14) ; also on sheet 1
FSMC_D12: U31.68(PE15) ; also on sheet 1
FSMC_D13: U31.77(PD8) ; also on sheet 1
FSMC_D14: U31.78(PD9) ; also on sheet 1
FSMC_D15: U31.79(PD10) ; also on sheet 1
FSMC_LB#: U31.141(PE0) ; also on sheet 1
FSMC_OE#: U31.118(PD4) ; also on sheet 1
FSMC_UB#: U31.142(PE1) ; also on sheet 1
FSMC_WE#: U31.119(PD5) ; also on sheet 1
I2C1_SCL: CN4.2 R69.2 R71.1 R74.2 U31.139(PB8)
I2C1_SDA: CN4.1 R21.2 R68.2 R70.1 U31.140(PB9)
LC02_CS: R32.1 U31.73(PB12)
LC02_CS_R: CN3.5 R28.1 R32.2 R107.2
LC02_RXD: CN3.4 R27.1 R31.2
LC02_TXD: CN3.3 R26.1 R30.2
LIS_CS: R22.1 R23.2 U17.3(CS)
LIS_INT: R24.1 R25.2 R78.2 U17.7(INT/DRDY/SDO) U31.42(PA6)
LIS_SCL: R72.1 R74.1 U17.1(SCL/SPC)
LIS_SDA: R21.1 R73.1 U17.4(SDA/SDI/SDO)
MPU6050_AUX_CL: R72.2 U16.7(AUX_CL)
MPU6050_AUX_DA: R73.2 U16.6(AUX_DA)
MPU6050_INT: R67.1 TP8.1 U31.22(PF10)
NRST: C58.1 H12.2 R89.2 SW4.1 U31.25(NRST)
OSC32_IN: C57.2 U31.8(PC14-OSC32_IN(PC14)) X2.1
OSC32_OUT: C56.2 U31.9(PC15-OSC32_OUT(PC15)) X2.2
OSC_IN: C55.2 R88.1 U31.23(PH0-OSC_IN(PH0)) X1.3
OSC_OUT: C54.2 R88.2 U31.24(PH1-OSC_OUT(PH1)) X1.1
PDR_ON: R39.1 R40.2 U31.143(PDR_ON)
SD_CLK: U31.113(PC12) ; also on sheet 1
SD_CMD: U31.116(PD2) ; also on sheet 1
SD_DAT0: U31.98(PC8) ; also on sheet 1
SD_DAT1: U31.99(PC9) ; also on sheet 1
SD_DAT2: U31.111(PC10) ; also on sheet 1
SD_DAT3: U31.112(PC11) ; also on sheet 1
SPI1_CLK: R77.2 U31.133(PB3(JTDOTRACESWO))
SPI1_CS: R82.2 U31.104(PA12)
SPI1_MOSI: R79.2 U31.135(PB5)
SWCLK: H12.4 U31.109(PA14(JTCK-SWCLK))
SWDIO: H12.3 U31.105(PA13(JTMS-SWDIO))
TIM3_CH1: U31.96(PC6) ; also on sheet 1
UART4_RX: R36.1 U31.35(PA1)
UART4_TX: R35.1 U31.34(PA0-WKUP(PA0))
USART1_RX: H11.2 R33.1 U31.102(PA10)
USART1_TX: H11.3 R34.1 U31.101(PA9)
USART2_RX: H4.2 H8.2 U31.37(PA3)
USART2_TX: H4.3 H9.2 U31.36(PA2)
USART3_RX: R30.1 TP20.1 U31.70(PB11) ; also on sheet 1
USART3_TX: R31.1 TP19.1 U31.69(PB10) ; also on sheet 1
$2N204: R64.1 USB1.4(CC1)
$2N205: R1.1 USB1.10(CC2)
$2N447: R34.2 U1.7(RXD)
$2N448: R33.2 U1.6(TXD)
$2N1006: R36.2 U22.3
$2N1007: R35.2 U22.2
$2N1573: R66.2 U16.9(AD0)
$2N1574: C11.2 U16.10(REGOUT)
$2N1575: R67.2 U16.12(INT)
$2N1580: C26.1 U16.20(CPOUT)
$2N1581: R68.1 U16.24(SDA)
$2N1582: R69.1 U16.23(SCL)
$2N2781: C30.2 U17.5(C1)
$2N7074: R75.2 U30.3(EN)
$2N7151: H8.1 H8.3 R85.2
$2N7152: H9.1 H9.3 R76.2
Net-(C52-2): C52.2 R81.2 SW1.4
Net-(C53-2): C53.2 R84.2 SW3.4
Net-(C58-2): C58.2 R106.1 SW4.2
Net-(R90-1): R90.1 TP17.1
Net-(R91-2): R91.2 TP18.1

Not connected (* = marked no-connect by the designer): CN3 6*; SW1 2* 3*; SW3 2* 3*; U1 4(RTS#)*; U16 2(NC)* 3(NC)* 4(NC)* 5(NC)* 14(NC)* 15(NC)* 16(NC)* 17(NC)* 19(RESV)* 21(RESV)* 22(RESV)*; U17 2(NC)* 11(NC)* 12(NC)*; U30 2(ADC)* 4(GPIO16)* 11(GPIO2)* 13(GPIO4)* 14(GPIO5)* 17(CS0)* 18(MISO)* 19(GPIO9)* 20(GPIO10)* 21(MOSI)* 22(SCLK)*; U31 1(PE2)* 2(PE3)* 3(PE4)* 4(PE5)* 5(PE6)* 7(PC13)* 18(PF6)* 19(PF7)* 20(PF8)* 21(PF9)* 27(PC1)* 28(PC2)* 29(PC3)* 40(PA4)* 41(PA5)* 43(PA7)* 44(PC4)* 45(PC5)* 46(PB0)* 47(PB1)* 49(PF11)* 74(PB13)* 75(PB14)* 76(PB15)* 91(PG6)* 92(PG7)* 97(PC7)* 100(PA8)* 103(PA11)* 110(PA15(JTDI))* 117(PD3)* 122(PD6)* 123(PD7)* 124(PG9)* 126(PG11)* 128(PG13)* 132(PG15)* 134(PB4(NJTRST))* 136(PB6)* 137(PB7)*; USB1 2(VBUS)* 3(SBU2)* 9(SBU1)* 11(VBUS)*

## Notes on the sheets
sheet 2
- 仅仅做通信使用
- 走差分对
- 说明：
  预留Openmv4接口；
  对 MICRO-USB进行修改，换成XH2.54座子；
- Type-C座子
- CH340 USB转串口
- OPENMV4
- PCB:走高速信号；
- PCB:走高速信号；
- 解释：
  VLOGIC ---> IO口电平；
  AD0 ---> 低位地址；
  REGOUT ---> 接稳压电容；
  FSYNC ---> 同步数字帧，不用就接地；
  INT ---> 输出中断；
- I2C地址：0XD0
- MPU6050 陀螺仪+加速度计
- 说明：
  1.TX 与 RX 那个 0R 电阻是为了提高容错性；
  2.CS是片选信号，低电平有效；
  3.根据 2 可知，CS_R平时拉低，
     若要复用串口，把0R电阻去掉，焊接1K电阻，和到GPIO的0R；
- PCB:走高速信号；
- Vdd_IO 给一个100nF的；
  Vdd 靠近引脚给一个100nf，再来一个10uf；
- TF-LC02 激光雷达模块
- 说明：
  IO0拉低时，进入下载模式；
  TX0，RX0平时接STM32串口，
  需要外部调试时，可以用跳线帽接外部串口；
- WIFI
- I2C默认地址：0x1E
- 1.那两根I2C先默认连接到MPU6050，看下能不能调得通，调不通用0R电阻再换到 I2C1 总线上去；
  2.CS 选择 I2C/SPI ，上拉I2C，接地SPI；
  3.LIS_INT 寄存器修改功能，PA6的SPI1_MISO ，也可以复用成GPIO；
  4.I2C支持 100KHz/400KHz/1MHz/3.4MHz；
- LIS2MDLTR 磁力计
sheet 3
- USART1 ---> USB_TypeC
- USART2 ---> ESP12F
- USART3 ---> TF-LC02
- USRT4 ---> OPENMV4
- 引出串口
- 复位电路
- PCB:走高速信号；
- I2C1 ---> MPU6050;
          ---> LIS2MDLTR;
          ---> PCA9685;
- 驱动PCA9685
- FSMC ---> RAM
- STLINK
- PB12 ---> LC02_CS 控制 激光雷达使能
- PF10 ---> MPU6050_INT 输出中断
- PB5 ---> VBAT_LED_G
  PB7 ---> VBAT_LED_R
  PG14 ---> VBAT_LED_B
- 高电平时，掉电复位；
  低电平时，不会
- GPIO
- PDR
- TIM3_CH1 ---> BUZZER
- 晶振电路
- PWM
- ADC123_IN10 ---> VBAT
- ADC
- 滤波电容 VDDA 部分
- SPI1 ---> ESP12F
- SPI
- 滤波电容 VREF+ 部分
- 滤波电容 VCAP 部分
- BOOT
- 供电
- 滤波电容 VDD 部分
- MCU
